# EasyEDA Pro project csgo-3版.eprj

# Schematic Schematic1
Create Date: 2023-11-17; Page Name: 【平衡车】STM32F103VCT6; Project Name: csgo; Schematic Name: Schematic1; Update Date: 2023-12-19; Company: 嘉立创EDA
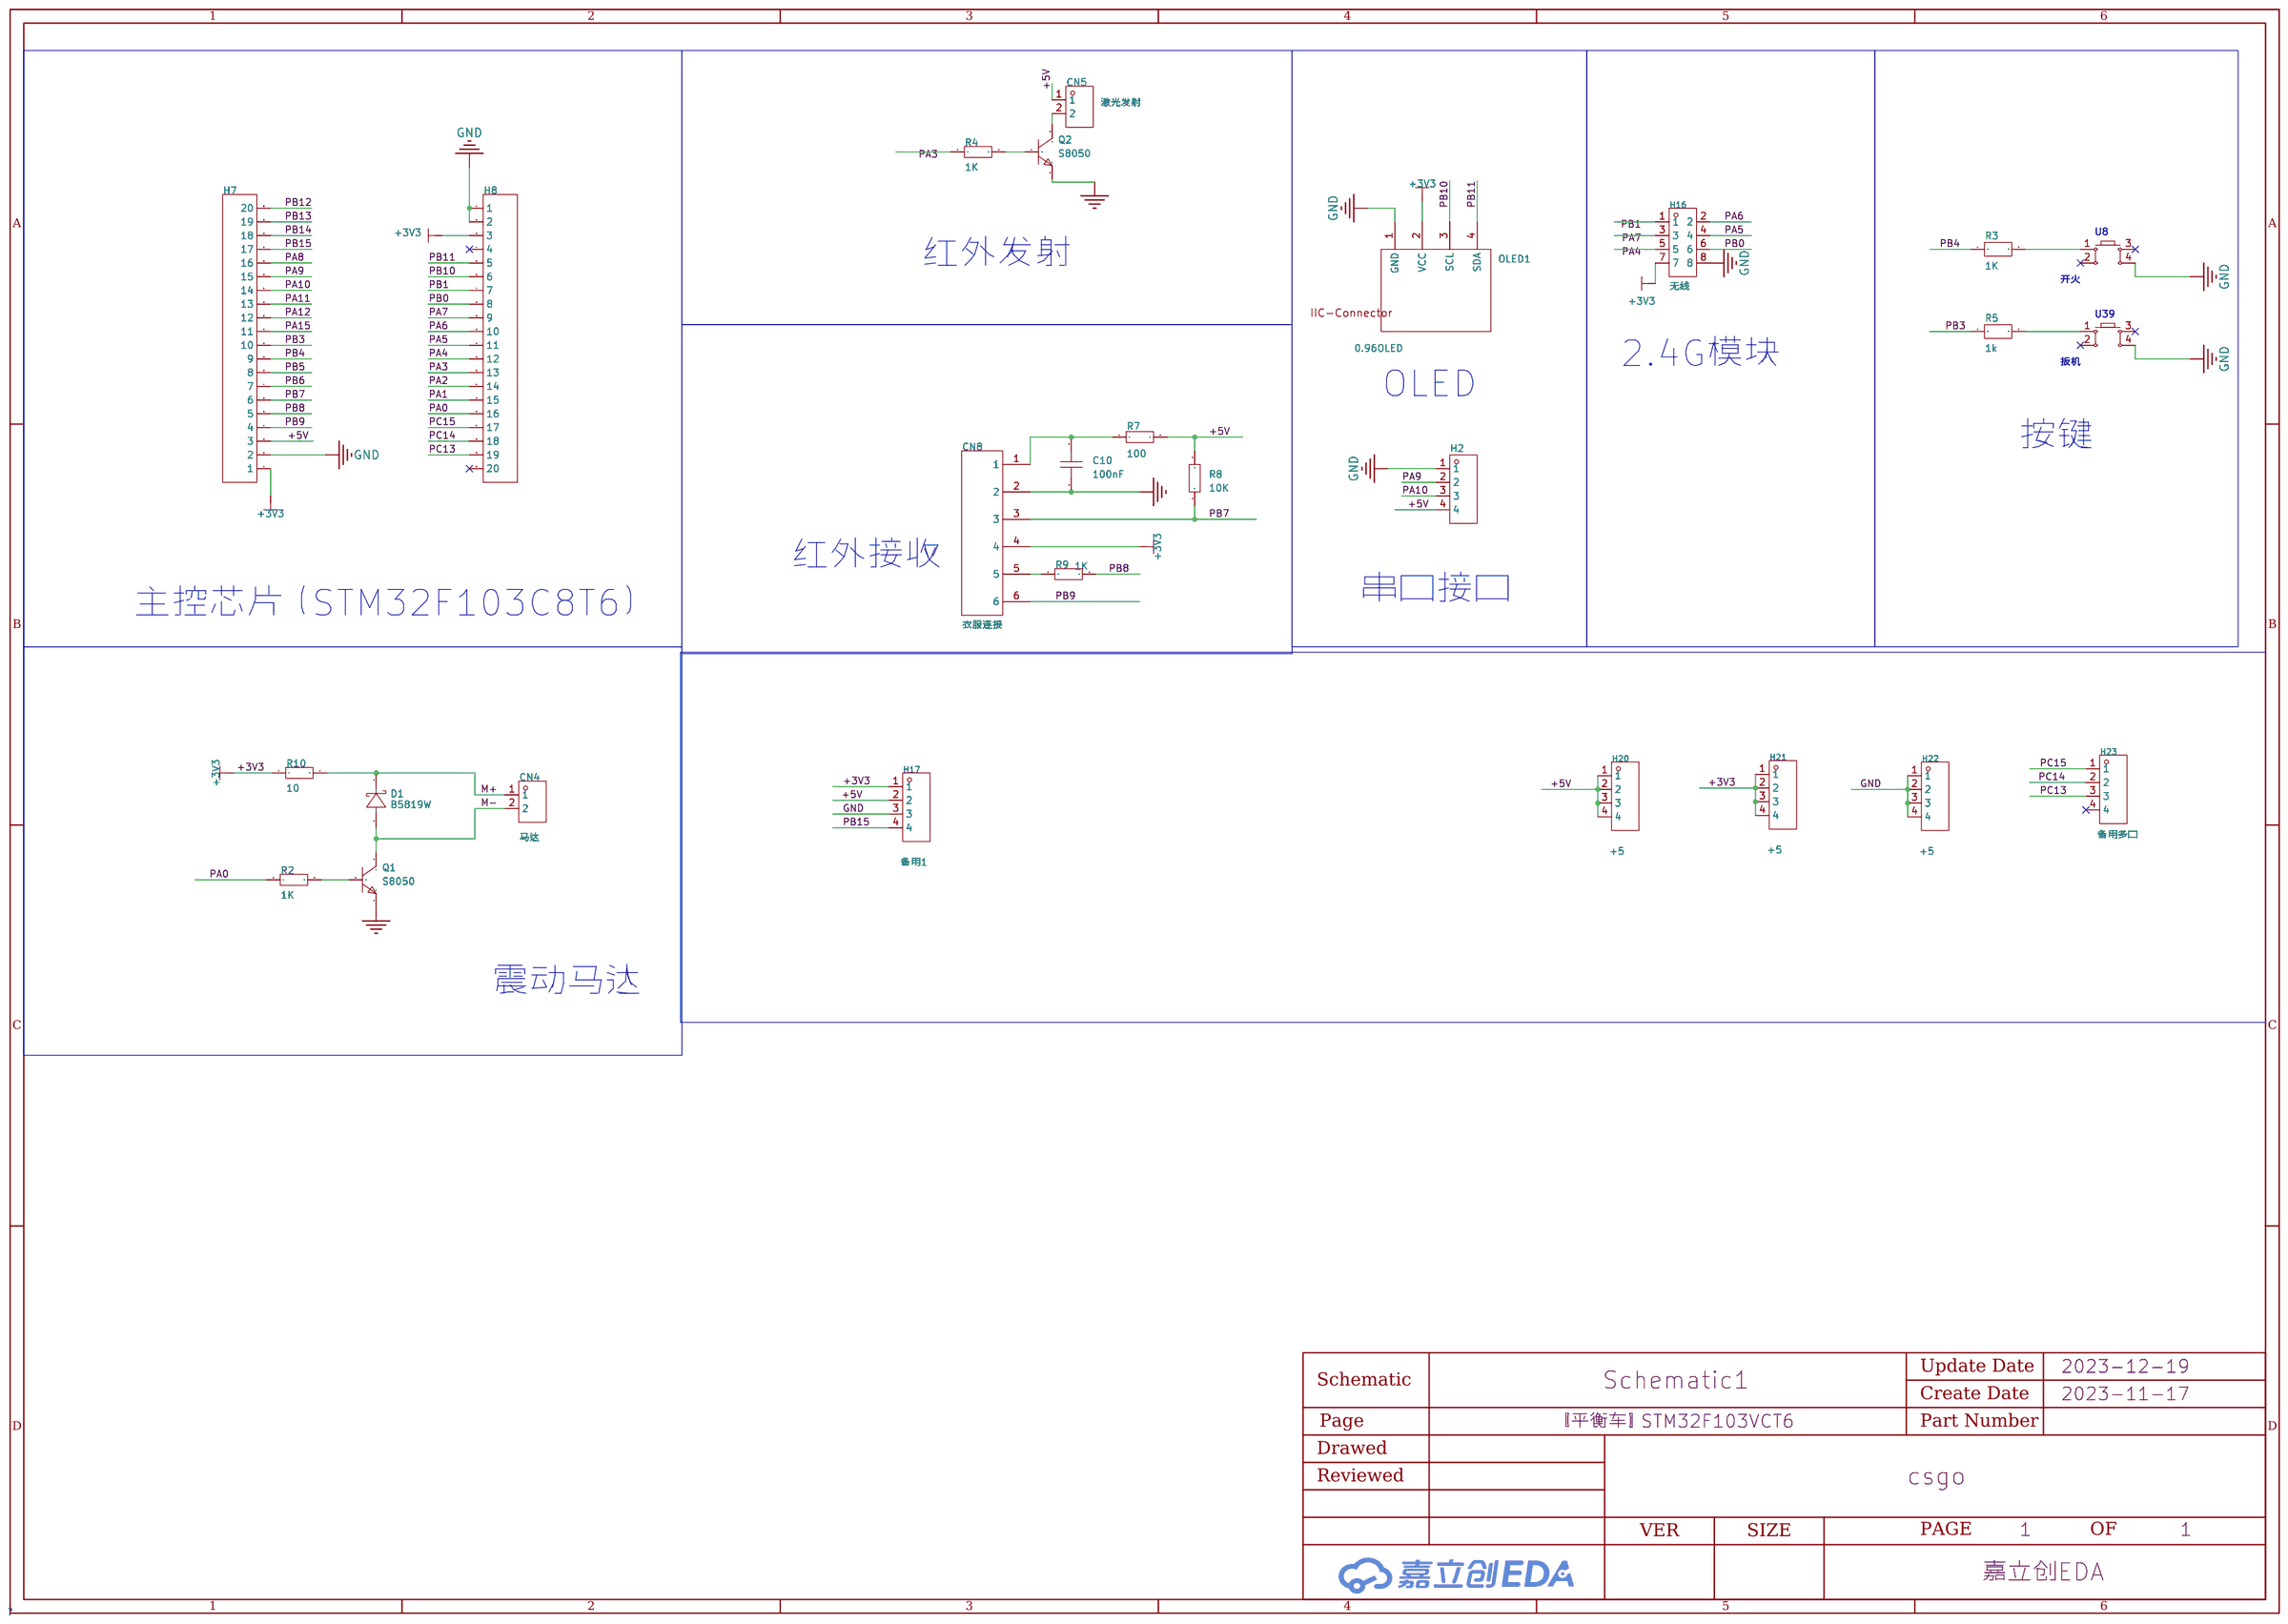
[diagram p0: schematic sheet]

## Parts
C10  100nF  [C0603]
CN4  马达  [CONN-TH_2P-P2.00_L5.1-W6.0]
CN5  激光发射  [CONN-TH_2P-P2.00_L5.1-W6.0]
CN8  衣服连接  [CONN-TH_B6B-PH-K-S]
D1  B5819W  [SOD-123F_L2.7-W1.6-LS3.8-RD-1]
H2  -  [HDR-TH_4P-P2.54-V-F]
H7  -  [HDR-TH_20P-P2.54-V-F]
H8  -  [HDR-TH_20P-P2.54-V-F]
H16  无线  [HDR-TH_8P-P2.54-V-M-R2-C4-S2.54]
H17  备用1  [HDR-TH_4P-P2.54-V-M]
H20  +5  [HDR-TH_4P-P2.54-V-M]
H21  +5  [HDR-TH_4P-P2.54-V-M]
H22  +5  [HDR-TH_4P-P2.54-V-M]
H23  备用多口  [HDR-TH_4P-P2.54-V-M]
OLED1  0.96OLED  [0.96OLED_4P]
Q1  S8050  [SOT-23-3_L2.9-W1.3-P1.90-LS2.4-BR]
Q2  S8050  [SOT-23-3_L2.9-W1.3-P1.90-LS2.4-BR]
R2  1K  [R0603]
R3  1K  [R0805]
R4  1K  [R0603]
R5  1k  [R0805]
R7  100  [R0603]
R8  10K  [R0603]
R9  1K  [R0603]
R10  10  [R0603]
U8  开火  [SW-TH_4P-L6.0-W6.0-P4.50-LS6.5]
U39  扳机  [SW-TH_4P-L6.0-W6.0-P4.50-LS6.5]

## Library data of the parts
C10 = CAP_0603: Supplier Footprint: 0603
CN4 CN5 = X2011WV-02A-N0SN: 参考系列:PH;间距:2mm;插针结构:1x2P;排数:1;每排PIN数:2;行距:-;公母:母型插口;安装方式:直插;额定电流:3A;触头材质:黄铜;触头镀层:锡;工作温度范围:-25℃~+85℃;焊接温度(最大值):260℃;; LCSC Part Name: PH 2mm 1x2P 直插 带锁扣; Supplier Part: C397442; Manufacturer: XKB Connectivity(中国星坤); Supplier Footprint: 插件,P=2mm; Datasheet: https://atta.szlcsc.com/upload/public/pdf/source/20211011/338B062DA88F50A4DA902C34474D3DC2.pdf; Supplier: LCSC; Reference Series: PH; Pitch: 2mm; Pins Structure: 1x2P; Number of Rows: 1; Number of PINs Per Row: 2; Gender: 母型插口; Mounting Style: 直插; Current Rating (Max): 3A; Contact Material: 黄铜; Contact Plating: 锡; Operating Temperature Range: -25℃~+85℃; Welding Temperature (Max): 260℃
CN8 = B6B-PH-K-S(LF)(SN): 参考系列:PH;间距:2mm;插针结构:1x6P;排数:1;每排PIN数:6;行距:-;安装方式:-;触头材质:黄铜;; LCSC Part Name: 系列:PH 间距:2mm 1x6P; Supplier Part: C131342; Manufacturer: JST; Supplier Footprint: 插件,P=2mm; JLCPCB Part Class: 扩展库; Datasheet: https://atta.szlcsc.com/upload/public/pdf/source/20171026/C131342_15089839687311058815.pdf; Supplier: LCSC; Reference Series: PH; Pitch: 2mm; Pins Structure: 1x6P; Number of Rows: 1; Number of PINs Per Row: 6; Contact Material: 黄铜
D1 = B5819W: 二极管配置:-;直流反向耐压(Vr):40V;平均整流电流(Io):1A;正向压降(Vf):580mV@1A;; LCSC Part Name: 40V 1A 580mV@1A; Supplier Part: C2943878; Manufacturer: GOODWORK(固得沃克); Supplier Footprint: SOD-123; Datasheet: https://atta.szlcsc.com/upload/public/pdf/source/20220114/81042131F39C8520B6390246D7392C1A.pdf; Supplier: LCSC; Reverse Voltage (Vr): 40V; Average Rectified Current (Io): 1A; Forward Voltage (Vf@If): 580mV@1A; Reverse Leakage Current (Ir): 50uA@40V
H2 = HDR-F_2.54_1x4P: Supplier Part: C2718488; Supplier Footprint: 插件
H7 H8 = HDR-F_2.54_1x20P: Supplier Part: C50984; Supplier Footprint: 插件
H16 = PZ254V-12-8P: 排数:双排;总PIN位数:8P;间距:2.54mm;插针结构:2x4P;行距:2.54mm;安装类型:直插;圆针/方针:方针;额定电流:-;额定电压:-;配合针长度:6mm;塑高:2.5mm;端接针长度:3mm;触头材质:黄铜;触头镀层:-;工作温度范围:-40℃~+105℃;颜色:黑色;; LCSC Part Name: 2.54mm 2x4P 直插 方针; Supplier Part: C492421; Manufacturer: XFCN(兴飞); Supplier Footprint: 插件,P=2.54mm; Datasheet: https://atta.szlcsc.com/upload/public/pdf/source/20200309/C492421_DC8A206AF99CD7755BD4A5B0BC48200B.pdf; Supplier: LCSC; Number of Rows: 双排; Number of Pins: 8P; Pitch: 2.54mm; Pin Structure: 2x4P; Row Spacing: 2.54mm; Mounting Type: 直插; Circluar Pins/Square Pins: 方针; Length of Mating Pin: 6mm; Insulation Height: 2.5mm; Length of End Connection Pin: 3mm; Contact Material: 黄铜; Operating Temperature Range: -40℃~+105℃; Color: 黑色
H17 H20-H23 = PZ254V-11-04P: 排数:单排;总PIN位数:4P;间距:2.54mm;插针结构:1x4P;行距:-;安装类型:直插;圆针/方针:方针;额定电流:3A;额定电压:250V;配合针长度:6mm;塑高:2.5mm;端接针长度:3mm;触头材质:-;工作温度范围:-40℃~+105℃;颜色:黑色;; LCSC Part Name: 2.54mm 1x4P 直插 方针; Supplier Part: C2691448; Manufacturer: XFCN(兴飞); Supplier Footprint: 插件,P=2.54mm; Datasheet: https://atta.szlcsc.com/upload/public/pdf/source/20200309/C492403_F9F19131791D08044AD4F84F8E751A34.pdf; Supplier: LCSC; Number of Rows: 单排; Number of Pins: 4P; Pitch: 2.54mm; Pin Structure: 1x4P; Mounting Type: 直插; Circluar Pins/Square Pins: 方针; Current Rating (Max): 3A; Voltage Rating (Max): 250V; Length of Mating Pin: 6mm; Insulation Height: 2.5mm; Length of End Connection Pin: 3mm; Operating Temperature Range: -40℃~+105℃; Color: 黑色
OLED1 = 0.96OLED_4P_MODULE_JX: Supplier Part: C9900004566; Supplier Footprint: THrough hole; JLCPCB Part Class: 扩展库; Datasheet: https://atta.szlcsc.comnull; Supplier: LCSC
Q1 Q2 = S8050_C727135: 晶体管类型:NPN;集射极击穿电压(Vceo):25V;集电极电流(Ic):500mA;功率(Pd):300mW;集电极-发射极饱和电压(VCE(sat)@Ic,Ib):600mV@500mA,50mA;直流电流增益(hFE@Ic,Vce):200@50mA,1V;特征频率(fT):150MHz;工作温度:+150℃@(Tj);; Supplier Part: C727135; Manufacturer: TWGMC(台湾迪嘉); Supplier Footprint: SOT-23; Datasheet: https://atta.szlcsc.com/upload/public/pdf/source/20200827/C727135_886F8A3C4345331EAE2C4DB6DDD31502.pdf; Supplier: LCSC; Transistor Type: NPN; Collector-Emitter Breakdown Voltage (Vceo): 25V; Collector Current (Ic): 500mA; Power Dissipation (Pd): 300mW; Collector-Emitter Saturation Voltage (VCE(sat)@Ic,Ib): 600mV@500mA,50mA; DC Current Gain (hFE@Ic,Vce): 200@50mA,1V; Transition Frequency (fT): 150MHz; Operating Temperature: +150℃@(Tj)
R2 R4 R7-R10 = Res_0603: Supplier Footprint: 0603
R3 R5 = SCR0805J2K: LCSC Part Name: ±5% 2K; Supplier Part: C3017846; Manufacturer: VO(翔胜); Supplier Footprint: 0805; Datasheet: https://atta.szlcsc.com/upload/public/pdf/source/20220513/247AF9639BA21CF93567DC289CCC6A22.pdf; Supplier: LCSC
U8 U39 = 轻触按键直插: LCSC Part Name: STC8G1K08A; Supplier Part: C9900022465; Supplier Footprint: SOP-8; JLCPCB Part Class: 扩展库; Datasheet: https://atta.szlcsc.comnull; Supplier: LCSC

## Nets
+3V3: CN8.4 H7.1 H8.3 H16.7 H17.1 H21.1 H21.2 H21.3 H21.4 OLED1.2(VCC) R10.1
+5V: CN5.1 H2.4 H7.3 H17.2 H20.1 H20.2 H20.3 H20.4 R7.2 R8.2
GND: C10.1 CN8.2 H2.1 H7.2 H8.1 H8.2 H16.8 H17.3 H22.1 H22.2 H22.3 H22.4 OLED1.1(GND) Q1.2(E) Q2.2(E) U8.4 U39.4
M+: CN4.1 D1.1(K) R10.2
M-: CN4.2 D1.2(A) Q1.3(C)
PA0: H8.16 R2.1
PA1: H8.15
PA2: H8.14
PA3: H8.13 R4.1
PA4: H8.12 H16.5
PA5: H8.11 H16.4
PA6: H8.10 H16.2
PA7: H8.9 H16.3
PA8: H7.16
PA9: H2.2 H7.15
PA10: H2.3 H7.14
PA11: H7.13
PA12: H7.12
PA15: H7.11
PB0: H8.8 H16.6
PB1: H8.7 H16.1
PB3: H7.10 R5.1
PB4: H7.9 R3.1
PB5: H7.8
PB6: H7.7
PB7: CN8.3 H7.6 R8.1
PB8: H7.5 R9.2
PB9: CN8.6 H7.4
PB10: H8.6 OLED1.3(SCL)
PB11: H8.5 OLED1.4(SDA)
PB12: H7.20
PB13: H7.19
PB14: H7.18
PB15: H7.17 H17.4
PC13: H8.19 H23.3
PC14: H8.18 H23.2
PC15: H8.17 H23.1
$1N51755: Q2.1(B) R4.2
$1N52364: Q1.1(B) R2.2
Net-(C10-2): C10.2 CN8.1 R7.1
Net-(CN5-2): CN5.2 Q2.3(C)
Net-(CN8-5): CN8.5 R9.1
Net-(R3-2): R3.2 U8.1
Net-(R5-2): R5.2 U39.1

Not connected (* = marked no-connect by the designer): H8 4* 20*; H23 4*; U8 2* 3*; U39 2* 3*

## Notes on the sheet
- 红外发射
- 2.4G模块
- OLED
- 按键
- 红外接收
- 串口接口
- 主控芯片（STM32F103C8T6）
- 震动马达

# Board PCB2
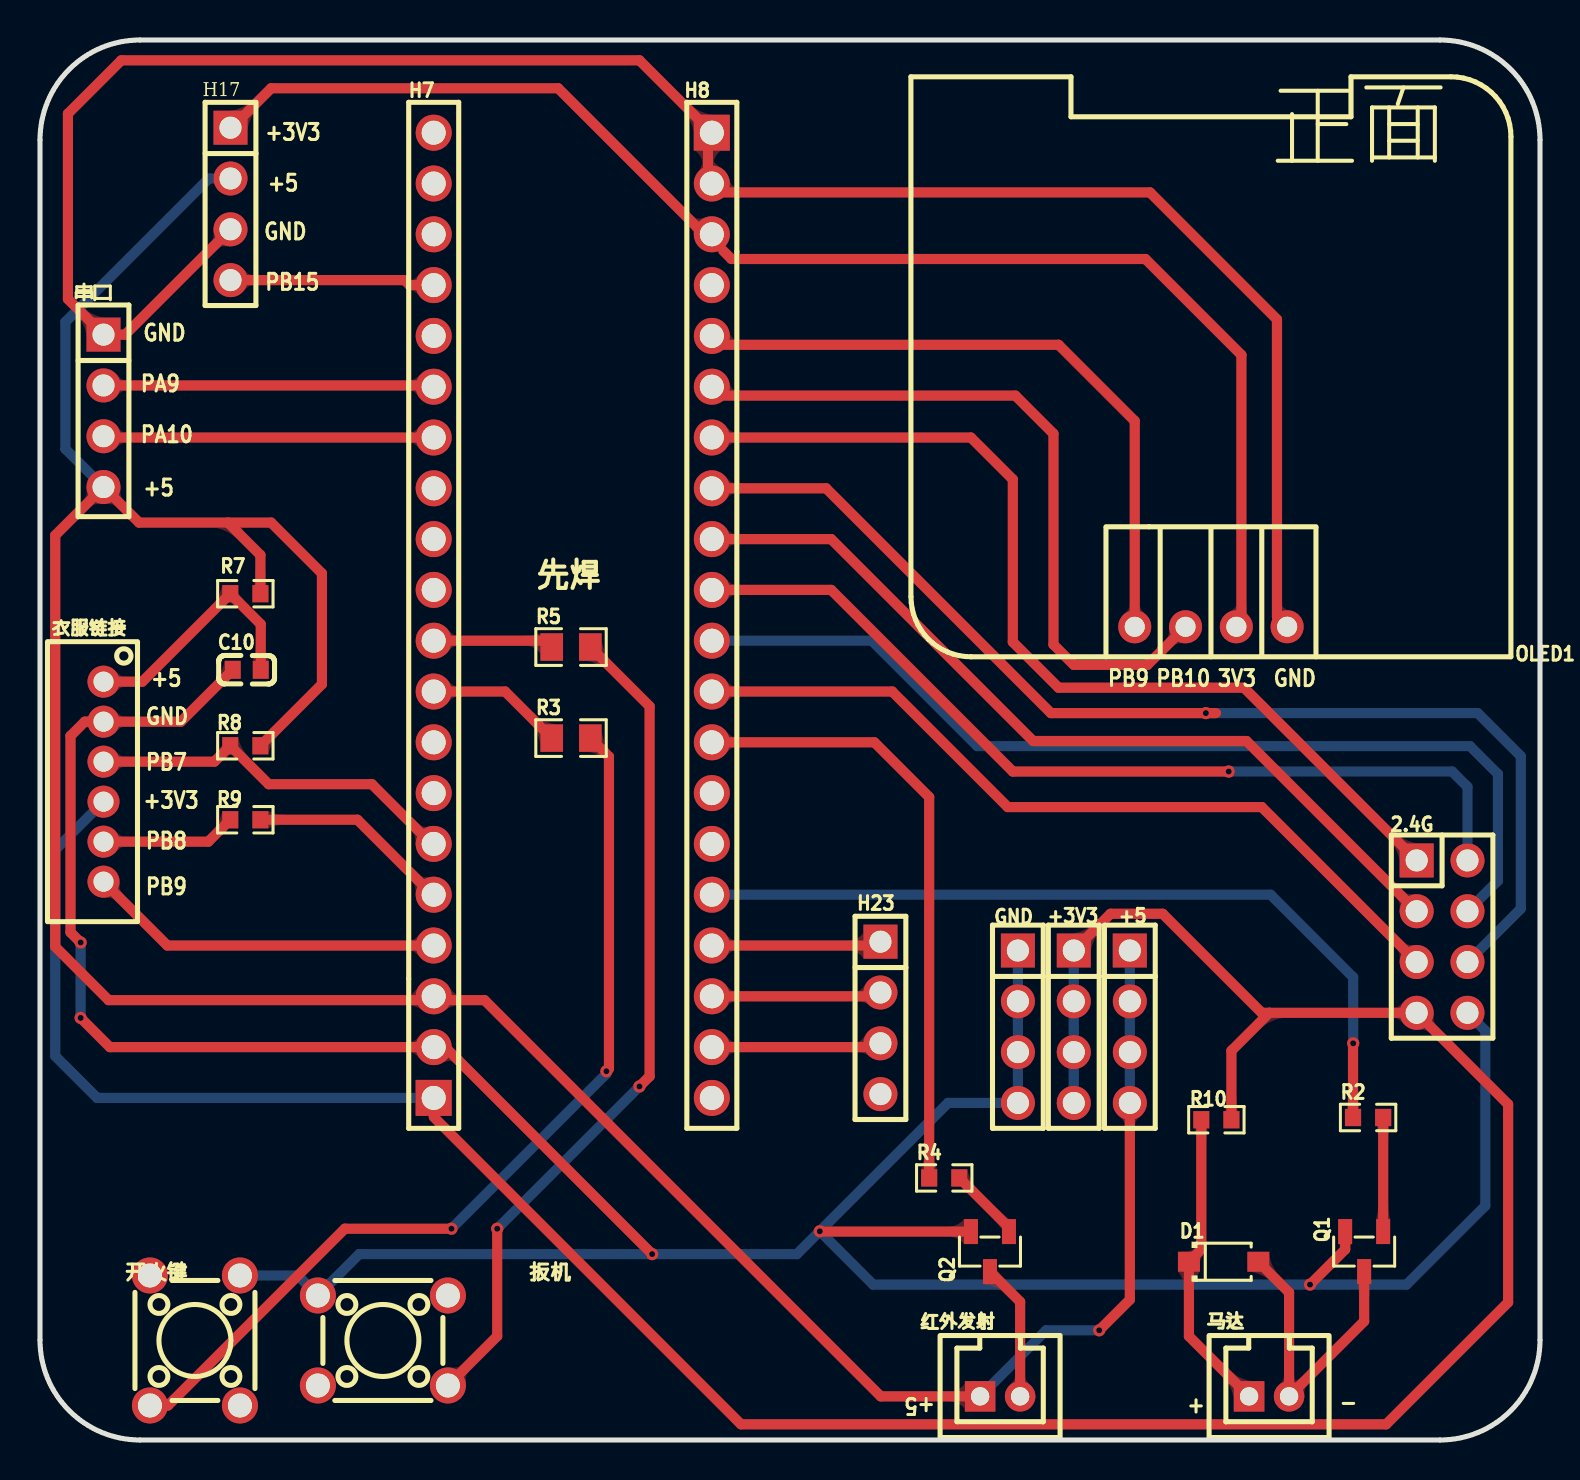
[diagram p1: board, top side]
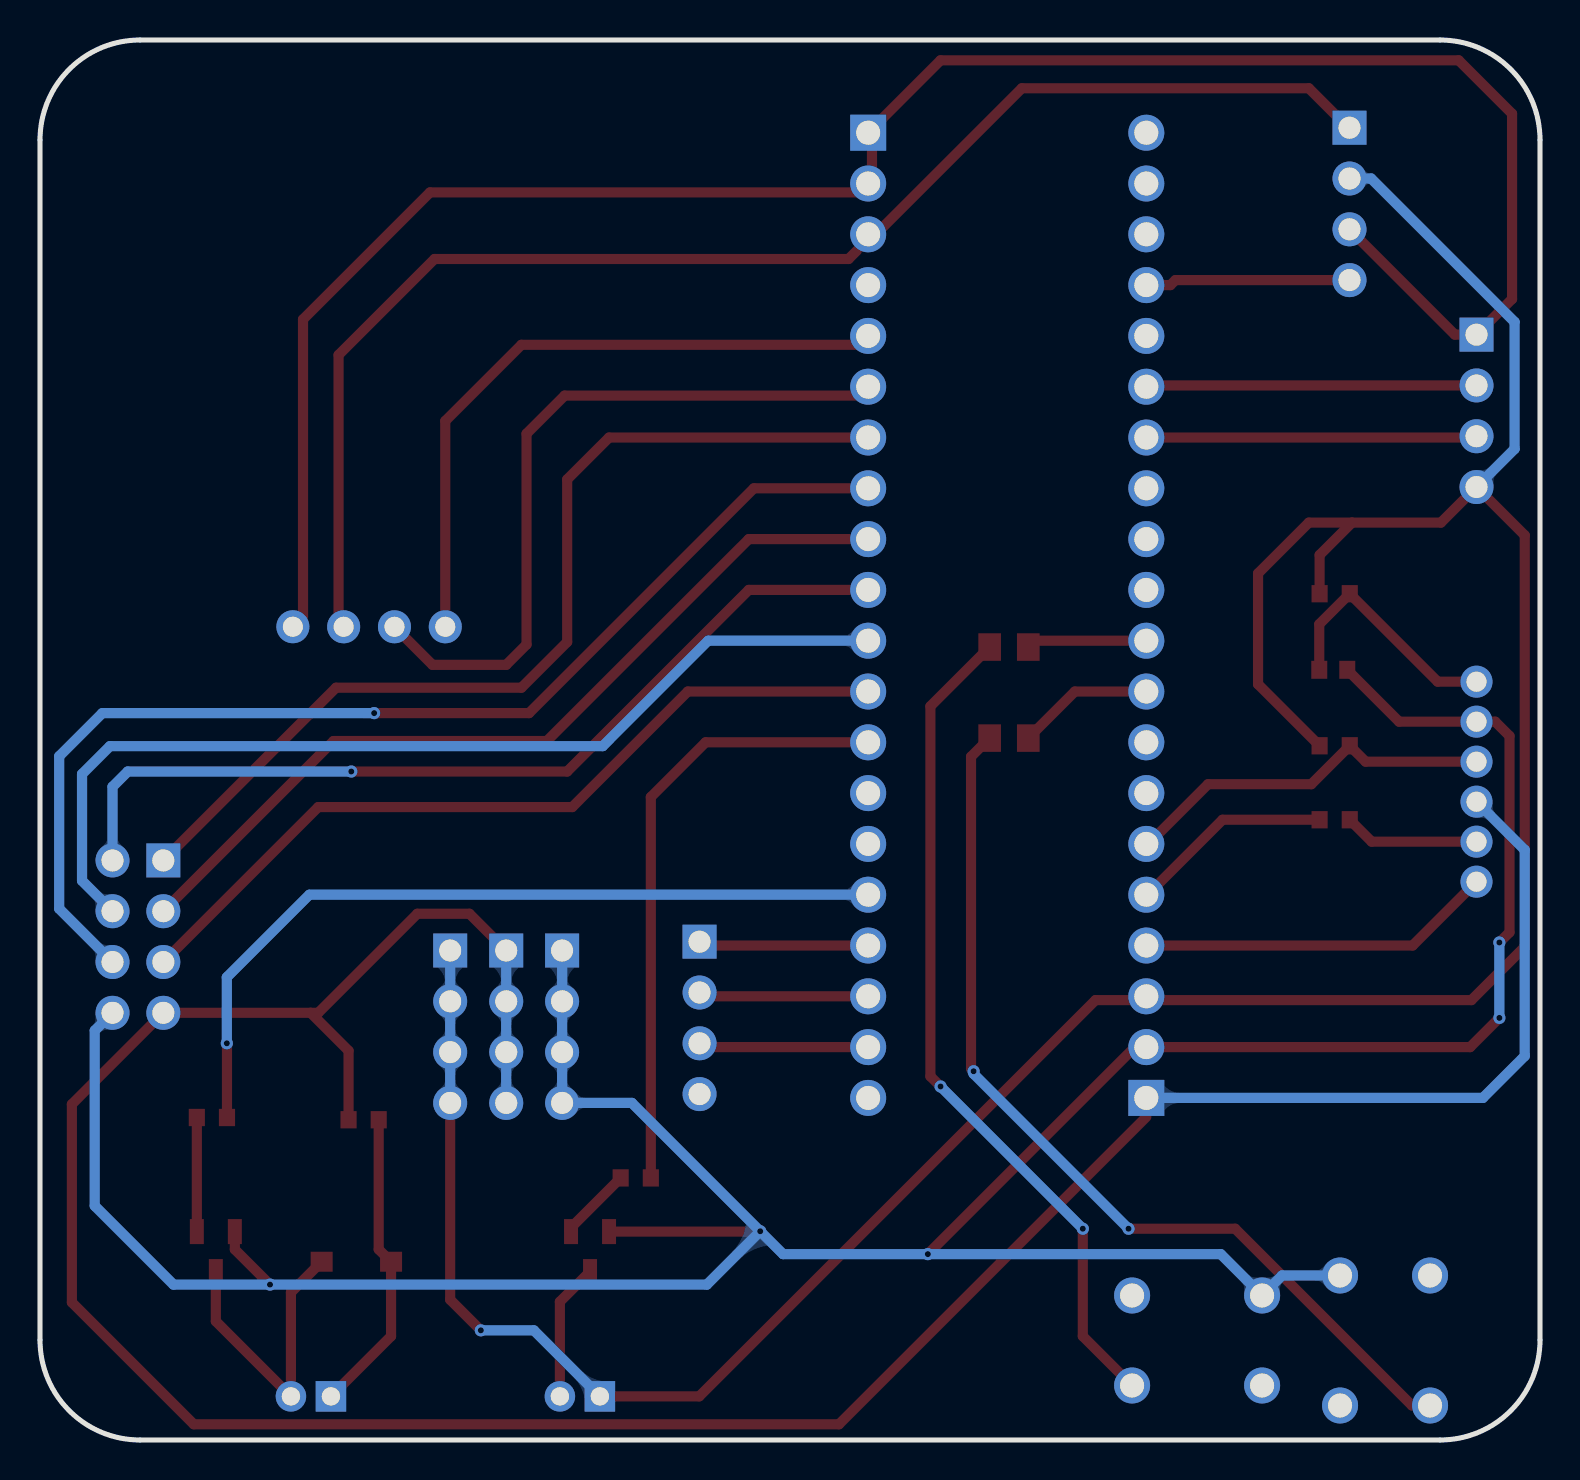
[diagram p2: board, bottom side, seen from below]

Outline 75 x 70 mm; copper layers: Top Layer, Bottom Layer. Coordinates in mm from the lower left corner of the outline.
Outline path: 0,65 0,5 arc(1.46,1.46) 5,0 70,0 arc(73.54,1.46) 75,5 75,65 arc(73.54,68.54) 70,70 5,70 arc(1.46,68.54) 0,65
Stack: Top Layer 0.035mm / Dielectric1 1.51mm FR4 er 4.5 / Bottom Layer 0.035mm

## Design rules (mm)
template: JLCPCB Capability(Two Layers Board)
spacing copperThickness1oz (default): track to track 0.102, other pairs 0.152 to 0.3
spacing copperThickness2oz: track to track 0.203, other pairs 0.152 to 0.3
track width copperThickness1oz (default): min 0.127, default 0.254, max 2.54
track width copperThickness2oz: min 0.203, default 0.254, max 2.54
differential pair differentialPair (default): width min 0.127, default 0.254, max 2.54; gap min 0.152, default 0.152
via viaSize (default): diameter min 0.5, default 0.61, max 10; hole min 0.3, default 0.305, max 6.3

## Placement (name value [footprint] x y rotation side)
2.4G  无线  [HDR-TH_8P-P2.54-V-M-R2-C4-S2.54]  70.1 25.17 270 top
+3V3  +5  [HDR-TH_4P-P2.54-V-M]  51.69 20.66 270 top
+5  +5  [HDR-TH_4P-P2.54-V-M]  54.49 20.66 270 top
C10  100nF  [C0603]  10.34 38.51 0 top
D1  B5819W  [SOD-123F_L2.7-W1.6-LS3.8-RD-1]  59.18 8.91 0 top
GND  +5  [HDR-TH_4P-P2.54-V-M]  48.9 20.66 270 top
H7  -  [HDR-TH_20P-P2.54-V-F]  19.69 41.23 90 top
H8  -  [HDR-TH_20P-P2.54-V-F]  33.59 41.23 270 top
H17  备用1  [HDR-TH_4P-P2.54-V-M]  9.53 61.8 270 top
H23  备用多口  [HDR-TH_4P-P2.54-V-M]  42.02 21.11 270 top
OLED1  0.96OLED  [0.96OLED_4P]  58.55 40.66 180 top
Q1  S8050  [SOT-23-3_L2.9-W1.3-P1.90-LS2.4-BR]  66.21 9.42 90 top
Q2  S8050  [SOT-23-3_L2.9-W1.3-P1.90-LS2.4-BR]  47.5 9.42 90 top
R2  1K  [R0603]  66.4 16.12 0 top
R3  1K  [R0805]  26.55 35.1 0 top
R4  1K  [R0603]  45.21 13.1 0 top
R5  1k  [R0805]  26.55 39.65 0 top
R7  100  [R0603]  10.27 42.31 0 top
R8  10K  [R0603]  10.27 34.71 0 top
R9  1K  [R0603]  10.27 31.01 0 top
R10  10  [R0603]  58.82 16.01 180 top
串口  -  [HDR-TH_4P-P2.54-V-F]  3.17 51.46 270 top
开火键  开火  [SW-TH_4P-L6.0-W6.0-P4.50-LS6.5]  7.75 4.98 90 top
扳机  扳机  [SW-TH_4P-L6.0-W6.0-P4.50-LS6.5]  17.14 4.98 180 top
红外发射  激光发射  [CONN-TH_2P-P2.00_L5.1-W6.0]  48.01 2.18 0 top
衣服链接  衣服连接  [CONN-TH_B6B-PH-K-S]  3.17 32.92 90 top
马达  马达  [CONN-TH_2P-P2.00_L5.1-W6.0]  61.45 2.18 0 top

## Footprints (pads in the part's own frame, mm; a bottom-side part is the same pattern mirrored in y, then rotated)
0.96OLED_4P
  round 1.651 hole 1.001: 1(-3.81,0) 2(-1.27,0.003) 3(1.27,0.003) 4(3.81,0.003)
C0603
  rect 0.8x0.9 smd: 1(-0.7,0) 2(0.7,0)
CONN-TH_2P-P2.00_L5.1-W6.0
  rect 1.524x1.524 hole 0.914: 1(-1,0)
  round 1.524 hole 0.914: 2(1,0)
CONN-TH_B6B-PH-K-S
  round 1.6 hole 1: 1(5,0) 2(3,0) 3(1,0) 4(-1,0) 5(-3,0) 6(-5,0)
HDR-TH_4P-P2.54-V-F
  rect 1.7x1.7 hole 1.1: 1(-3.81,0)
  round 1.7 hole 1.1: 2(-1.27,0) 3(1.27,0) 4(3.81,0)
HDR-TH_4P-P2.54-V-M
  rect 1.7x1.7 hole 1.1: 1(-3.81,0)
  round 1.7 hole 1.1: 2(-1.27,0) 3(1.27,0) 4(3.81,0)
HDR-TH_8P-P2.54-V-M-R2-C4-S2.54
  rect 1.7x1.7 hole 1.1: 1(-3.81,-1.27)
  round 1.7 hole 1.1: 2(-3.81,1.27) 3(-1.27,-1.27) 4(-1.27,1.27) 5(1.27,-1.27) 6(1.27,1.27) 7(3.81,-1.27) 8(3.81,1.27)
HDR-TH_20P-P2.54-V-F
  rect 1.8x1.8 hole 1.2: 1(-24.13,0)
  round 1.8 hole 1.2: 2(-21.59,0) 3(-19.05,0) 4(-16.51,0) 5(-13.97,0) 6(-11.43,0) 7(-8.89,0) 8(-6.35,0) 9(-3.81,0) 10(-1.27,0) 11(1.27,0) 12(3.81,0) 13(6.35,0) 14(8.89,0) 15(11.43,0) 16(13.97,0) 17(16.51,0) 18(19.05,0) 19(21.59,0) 20(24.13,0)
R0603
  rect 0.806x0.864 smd: 1(-0.753,0) 2(0.753,0)
R0805
  rect 1.133x1.377 smd: 1(-0.966,0) 2(0.966,0)
SOD-123F_L2.7-W1.6-LS3.8-RD-1
  rect 1.1x1 smd: 1(-1.735,0) 2(1.735,0)
SOT-23-3_L2.9-W1.3-P1.90-LS2.4-BR
  rect 1.25x0.7 smd: 1(1,-0.95) 2(1,0.95) 3(-1,0)
SW-TH_4P-L6.0-W6.0-P4.50-LS6.5
  round 1.8 hole 1.2: 1(-3.25,2.25) 2(3.25,2.25) 3(-3.25,-2.25) 4(3.25,-2.25)

## Nets
+3V3: 2.4G.7 +3V3.1 +3V3.2 +3V3.3 +3V3.4 H7.1 H8.3 H17.1 OLED1.2 R10.1 衣服链接.4
+5V: +5.1 +5.2 +5.3 +5.4 H7.3 H17.2 R7.2 R8.2 串口.4 红外发射.1
GND: 2.4G.8 C10.1 GND.1 GND.2 GND.3 GND.4 H7.2 H8.1 H8.2 H17.3 OLED1.1 Q1.2 Q2.2 串口.1 开火键.4 扳机.4 衣服链接.2
M+: D1.1 R10.2 马达.1
M-: D1.2 Q1.3 马达.2
PA0: H8.16 R2.1
PA1: H8.15
PA2: H8.14
PA3: H8.13 R4.1
PA4: 2.4G.5 H8.12
PA5: 2.4G.4 H8.11
PA6: 2.4G.2 H8.10
PA7: 2.4G.3 H8.9
PA8: H7.16
PA9: H7.15 串口.2
PA10: H7.14 串口.3
PA11: H7.13
PA12: H7.12
PA15: H7.11
PB0: 2.4G.6 H8.8
PB1: 2.4G.1 H8.7
PB3: H7.10 R5.1
PB4: H7.9 R3.1
PB5: H7.8
PB6: H7.7
PB7: H7.6 R8.1 衣服链接.3
PB8: H7.5 R9.2
PB9: H7.4 衣服链接.6
PB10: H8.6 OLED1.3
PB11: H8.5 OLED1.4
PB12: H7.20
PB13: H7.19
PB14: H7.18
PB15: H7.17 H17.4
PC13: H8.19 H23.3
PC14: H8.18 H23.2
PC15: H8.17 H23.1
$1N43876: R3.2 开火键.1
$1N43878: R5.2 扳机.1
$1N51755: Q2.1 R4.2
$1N51875: Q2.3 红外发射.2
$1N52076: C10.2 R7.1 衣服链接.1
$1N52085: R9.1 衣服链接.5
$1N52364: Q1.1 R2.2

Pads without a net: H8 4 20; H23 4; 开火键 2 3; 扳机 2 3

## Via types
v1: diameter 0.61, hole 0.305, Top Layer to Bottom Layer, 13 vias

## Routing (per net, layer and track width the routed paths; a pad name or vN(x,y) marks a point on that pad's centre or on a via; arc(x,y) is an arc through that point)
+3V3: length 215.9
  Top Layer w0.508: +3V3.1 53.53,26.31 56.13,26.31 61.09,21.36 61.47,21.36 ; 61.47,21.36 2.4G.7 73.41,16.79 73.41,6.88 67.31,0.78 35.05,0.78 19.69,16.15 ; 61.47,21.36 59.57,19.46 R10.1 ; OLED1.2 60.07,40.91 60.07,54.25 55.27,59.05 34.57,59.05 34.16,59.46 ; H8.3 33.21,60.28 25.91,67.59 11.56,67.59 9.58,65.61 H17.1
  Bottom Layer w0.508: H7.1 2.86,17.1 0.76,19.2 0.76,29.5 衣服链接.4 ; +3V3.1 +3V3.2 +3V3.3 +3V3.4
+5V: length 153.6
  Top Layer w0.508: R8.2 14.1,37.79 14.1,43.33 11.56,45.87 9.4,45.87 ; +5.4 54.49,7.02 v1(52.96,5.48) ; 9.4,45.87 11.02,44.25 R7.2 ; 9.4,45.87 4.95,45.87 串口.4 0.76,45.23 0.76,24.66 3.43,21.99 22.22,21.99 42.04,2.18 红外发射.1
  Bottom Layer w0.508: +5.4 +5.3 +5.2 +5.1 ; v1(52.96,5.48) 50.31,5.48 红外发射.1 ; H17.2 8.44,63.07 1.27,55.9 1.27,49.55 串口.4
GND: length 269.3
  Top Layer w0.508: v1(2.03,21.11) 3.49,19.64 H7.2 20.26,19.64 v1(30.61,9.29) ; Q1.2 65.26,9.53 v1(63.5,7.77) ; C10.1 7.04,35.92 衣服链接.2 2.24,35.92 1.52,35.2 1.52,25.38 v1(2.03,24.88) ; H8.1 29.97,68.98 4.06,68.98 1.4,66.32 1.4,57.05 串口.1 4.26,55.27 H17.3 ; v1(38.99,10.44) 39,10.42 Q2.2 ; OLED1.1 61.85,41.17 61.85,56.03 55.5,62.38 34.04,62.38 33.4,63.02 33.4,64.92 33.15,64.92
  Bottom Layer w0.508: v1(38.99,10.44) 41.66,7.77 v1(63.5,7.77) 68.33,7.77 72.26,11.71 72.26,20.47 2.4G.8 ; v1(38.99,10.44) 45.41,16.85 GND.4 GND.3 GND.2 GND.1 ; v1(38.99,10.44) 37.85,9.29 v1(30.61,9.29) 15.96,9.29 扳机.4 12.89,8.23 开火键.4 ; v1(2.03,24.88) v1(2.03,21.11)
M+: length 15.3
  Top Layer w0.508: R10.2 58.06,9.53 57.45,8.91 57.45,5.19 马达.1
M-: length 15.2
  Top Layer w0.508: Q1.3 66.21,5.94 马达.2 62.45,7.38 D1.2
PA0: length 40.8
  Top Layer w0.508: R2.1 65.65,19.83 v1(65.66,19.83)
  Bottom Layer w0.508: v1(65.66,19.83) 65.66,23.14 61.53,27.26 H8.16
PA3: length 31
  Top Layer w0.508: R4.1 44.46,32.15 41.72,34.88 H8.13
PA4: length 40.8
  Top Layer w0.508: 2.4G.5 61.09,31.65 48.39,31.65 42.61,37.42 H8.12
PA5: length 49.6
  Bottom Layer w0.508: 2.4G.4 72.9,27.96 72.9,33.3 71.5,34.69 46.86,34.69 41.59,39.96 H8.11
PA6: length 45.5
  Top Layer w0.508: v1(59.44,33.42) 48.64,33.42 39.56,42.5 H8.10
  Bottom Layer w0.508: v1(59.44,33.42) 70.61,33.42 71.37,32.66 2.4G.2
PA7: length 42.9
  Top Layer w0.508: H8.9 39.56,45.04 49.66,34.95 60.32,34.95 2.4G.3
PA9: length 16.5
  Top Layer w0.508: 串口.2 19.62,52.73 H7.15
PA10: length 16.5
  Top Layer w0.508: H7.14 3.24,50.12 串口.3
PB0: length 57.9
  Top Layer w0.508: 58.8,36.34 50.55,36.34 39.31,47.58 H8.8
  Bottom Layer w0.508: 2.4G.6 74.04,26.57 74.04,34.19 71.88,36.34 v1(58.29,36.34)
PB1: length 48.8
  Top Layer w0.508: H8.7 46.55,50.12 48.64,48.03 48.64,39.9 50.93,37.61 60.2,37.61 2.4G.1
PB3: length 6
  Top Layer w0.508: 25.59,39.65 25.27,39.96 H7.10
PB4: length 6.9
  Top Layer w0.508: H7.9 23.26,37.42 25.59,35.1
PB7: length 18.8
  Top Layer w0.508: 衣服链接.3 8.72,33.92 R8.1 11.43,32.79 16.6,32.79 19.58,29.8
PB8: length 10.2
  Top Layer w0.508: R9.2 15.87,31.01 19.62,27.26
PB9: length 17.8
  Top Layer w0.508: H7.4 6.37,24.72 衣服链接.6
PB10: length 36.7
  Top Layer w0.508: OLED1.3 55.37,38.76 51.69,38.76 50.67,39.77 50.67,50.31 48.77,52.22 33.15,52.22
PB11: length 33.5
  Top Layer w0.508: OLED1.4 54.74,50.95 50.93,54.76 33.15,54.76
PB15: length 10.3
  Top Layer w0.508: H7.17 18.48,57.74 18.23,57.99 H17.4
PC13: length 8.5
  Top Layer w0.508: H8.19 41.83,19.64 H23.3
PC14: length 8.5
  Top Layer w0.508: H23.2 41.83,22.18 H8.18
PC15: length 8.5
  Top Layer w0.508: H8.17 41.83,24.72 H23.1
$1N43876: length 46.9
  Top Layer w0.508: v1(20.57,10.56) 15.24,10.56 6.4,1.73 开火键.1 ; R3.2 28.45,34.17 28.45,18.56 v1(28.32,18.44)
  Bottom Layer w0.508: v1(20.57,10.56) 28.32,18.31 v1(28.32,18.44)
$1N43878: length 42.3
  Top Layer w0.508: 20.4,2.73 22.86,5.19 v1(22.86,10.56) ; v1(29.97,17.68) 30.48,18.18 30.48,36.69 R5.2
  Bottom Layer w0.508: v1(22.86,10.56) v1(29.97,17.68)
$1N51755: length 3.8
  Top Layer w0.508: Q2.1 48.51,10.48 48.51,10.56 R4.2
$1N51875: length 6.9
  Top Layer w0.508: Q2.3 49.01,6.91 红外发射.2
$1N52076: length 12.6
  Top Layer w0.508: C10.2 11.04,40.79 R7.1 5.11,37.92 衣服链接.1
$1N52085: length 6.8
  Top Layer w0.508: 衣服链接.5 8.42,29.92 R9.1
$1N52364: length 5.7
  Top Layer w0.508: R2.2 Q1.1

## Copper pours and planes (outline as drawn; the poured copper is in the pictures)
GND on Top Layer: -11.43,83.97 100.97,83.97 100.97,4.47 -11.43,4.47
GND on Bottom Layer: -14.86,76.35 88.26,76.35 88.26,-5.18 -14.86,-5.18

Small or netless copper shapes (teardrops, artwork), in the pictures only: 96 on Top Layer, 34 on Bottom Layer

## Text on the board
Top Silkscreen Layer: PA9 | PA10 | GND | +5 | +3V3 | PB7 | PB8 | PB15 | PB9 | PB10 | + | 3V3 | - | 先焊 | 正面
